# EasyEDA Pro project STM32G303的双FOC电机驱动.eprj, board motor_drivev1.3
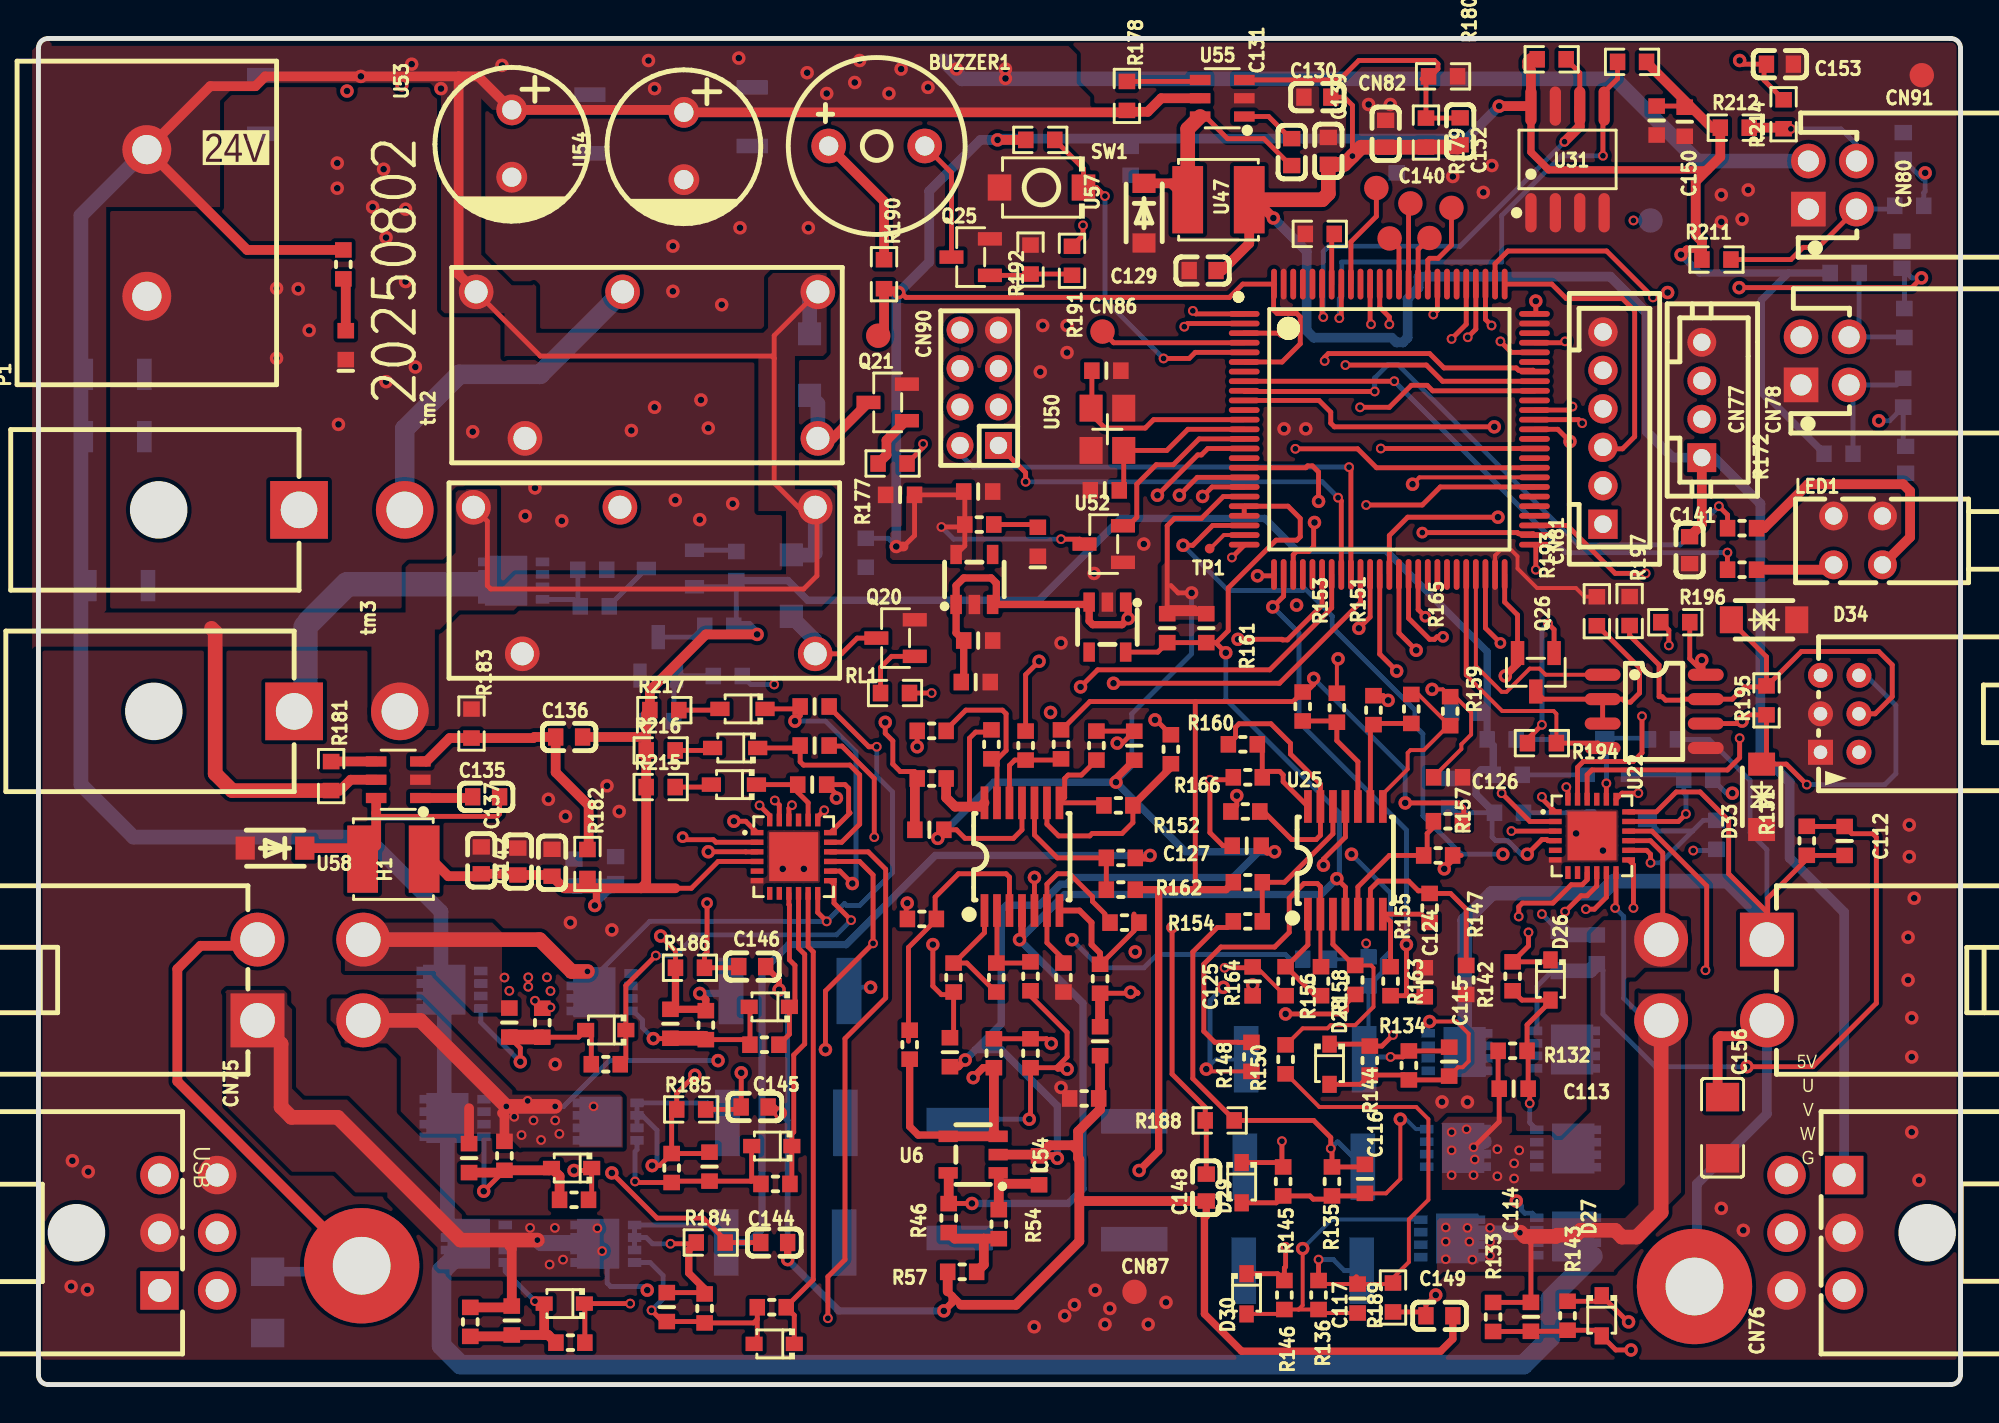
[diagram p11: board, top side]
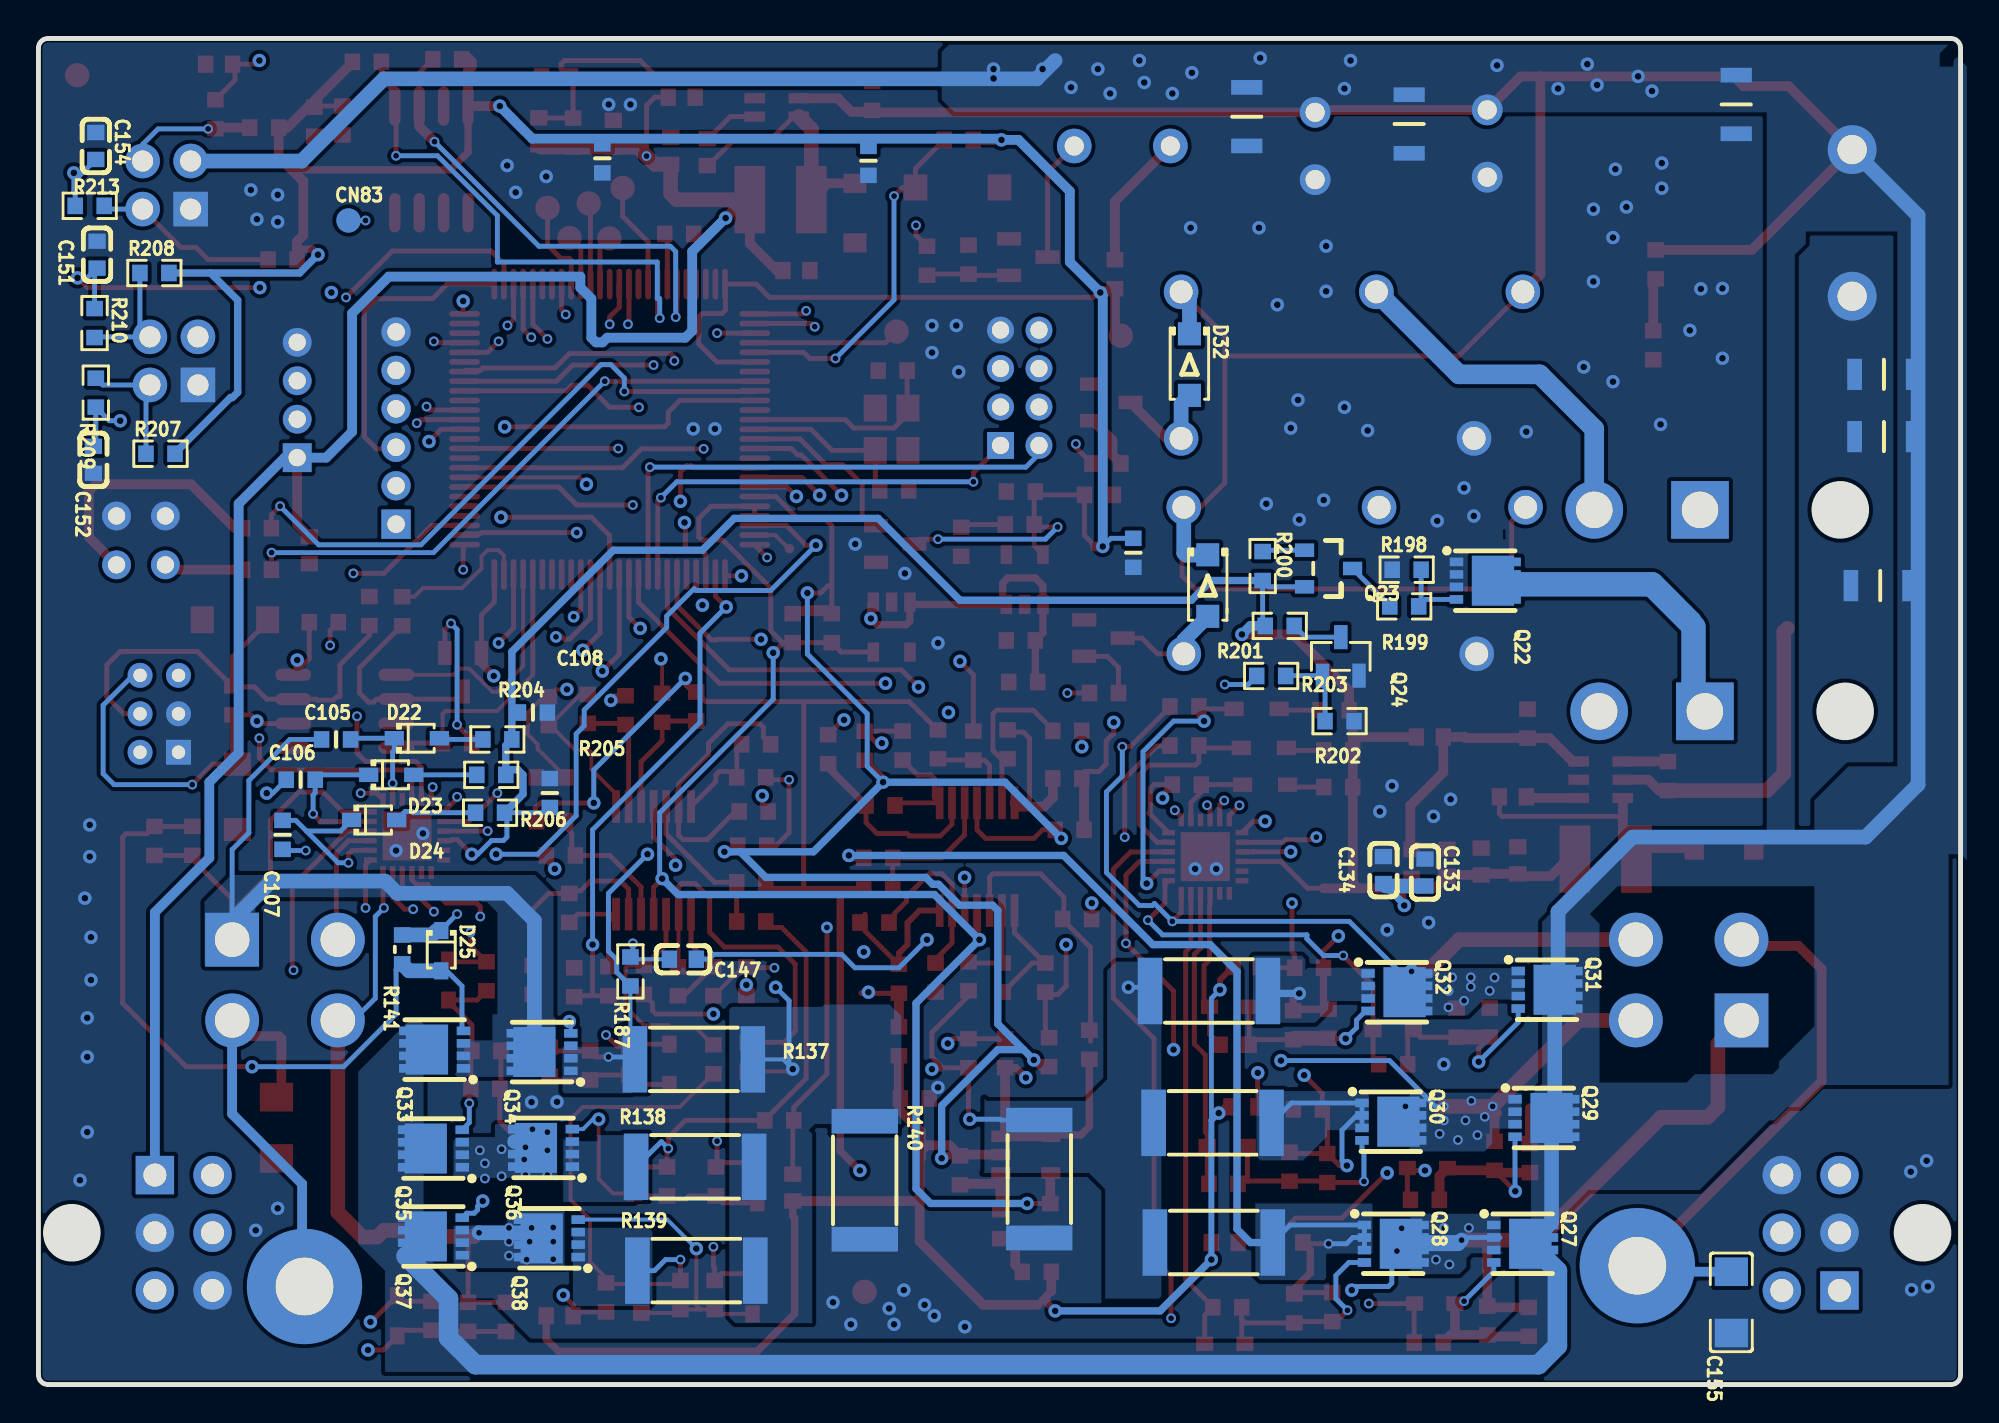
[diagram p12: board, bottom side, seen from below]

Outline 100 x 70 mm; copper layers: Top Layer, Inner1, Inner2, Bottom Layer. Coordinates in mm from the lower left corner of the outline.
Outline path: 0,69.5 arc(0.15,69.85) 0.5,70 99.5,70 arc(99.85,69.85) 100,69.5 100,0.5 arc(99.85,0.15) 99.5,0 0.5,0 arc(0.15,0.15) 0,0.5 0,69.5
Stack: Top Layer 0.035mm 外层铜厚1oz / Dielectric1 0.2104mm 7628 RC49% 8.6mil / Inner1 0.0152mm 内层铜厚 / Dielectric2 1.065mm 1.1mm H/HOZ Copper / Inner2 0.0152mm 内层铜厚 / Dielectric3 0.2104mm 7628 RC49% 8.6mil / Bottom Layer 0.035mm 外层铜厚1oz

## Design rules (mm)
template: 用户自定义配置
spacing safeClearance (default): track to track 0.152, other pairs 0.152 to 0.203
track width trackWidth (default): min 0.203, default 0.254, max 2.54
differential pair differentialPair (default): width min 0.152, default 0.254, max 2.54; gap min 0.152, default 0.203
via viaSize (default): diameter min 0.5, default 0.711, max 10; hole min 0.3, default 0.381, max 5.999
via mid: diameter min 0.5, default 0.762, max 10; hole min 0.3, default 0.406, max 6.3

## Placement (name value [footprint] x y rotation side)
BUZZER1  3kHz  [BUZ-TH_BD9.0-P5.00-D0.6-FD]  43.61 64.41 0 top
C5  10uF  [C1206_S]  3.86 49.3 0 bottom
C6  10uF  [C1206_S]  28.69 65.68 270 bottom
C12  10uF  [C1206_S]  4.05 41.55 0 bottom
C13  10uF  [C1206_S]  3.86 52.53 0 bottom
C14  10uF  [C1206_S]  11.67 66.69 270 bottom
C15  10uF  [C1206_S]  37.14 66.06 270 bottom
C30  100nF  [C0603_S]  48.88 38.69 180 top
C31  100nF  [C0603_S]  84.19 65.74 90 top
C32  100nF  [C0603_S]  70.66 63.77 90 bottom
C33  100nF  [C0603_S]  56.82 63.65 90 bottom
C34  22pF  [C0603_S]  55.55 52.72 180 top
C35  22pF  [C0603_S]  55.49 46.5 0 top
C41  100nF  [C0603_S]  48.76 36.53 180 top
C42  100nF  [C0603_S]  58.73 39.33 270 top
C43  100nF  [C0603_S]  60.76 39.33 270 top
C54  10nF  [C0603_S]  52.06 11.13 270 top
C55  100nF  [C0603_S]  48.88 46.44 180 top
C56  100nF  [C0603_S]  43.04 43.26 90 bottom
C57  100nF  [C0603_S]  44.84 46.26 0 top
C61  1nF  [C0603_S]  55.23 17.86 90 top
C62  1nF  [C0603_S]  47.42 17.29 90 top
C63  1nF  [C0603_S]  24.63 3.32 270 top
C64  1nF  [C0603_S]  22.4 11.77 270 top
C65  1nF  [C0603_S]  24.5 18.81 270 top
C66  1uF  [C0603_S]  40.25 31.2 180 top
C67  1nF  [C0603_S]  57.01 33.23 90 top
C68  1nF  [C0603_S]  46.34 28.85 180 top
C69  100nF  [C0603_S]  73.39 30.75 270 bottom
C70  1uF  [C0603_S]  40.37 33.23 180 top
C71  1uF  [C0603_S]  40.37 35.26 180 top
C72  1nF  [C0603_S]  32.69 4.02 270 top
C73  1nF  [C0603_S]  34.91 11.32 270 top
C74  1nF  [C0603_S]  32.88 18.75 270 top
C105  1uF  [C0603_S]  84.51 33.55 180 bottom
C106  1uF  [C0603_S]  86.35 31.45 180 bottom
C107  1uF  [C0603_S]  87.3 28.59 90 bottom
C108  100nF  [C0603_S]  74.28 34.94 0 bottom
C112  1nF  [C0603_S]  93.97 28.28 90 top
C113  1nF  [C0603_S]  76.76 15.39 0 top
C114  1nF  [C0603_S]  77.65 3.51 270 top
C115  1nF  [C0603_S]  73.39 16.78 270 top
C116  1nF  [C0603_S]  69.01 10.69 270 top
C117  1nF  [C0603_S]  68.63 4.46 270 top
C124  1nF  [C0603_S]  72.12 20.91 270 top
C125  1nF  [C0603_S]  63.17 20.97 90 top
C126  1nF  [C0603_S]  73.33 31.58 180 top
C127  1nF  [C0603_S]  62.85 28.02 180 top
C129  22uF  [C0603]  60.57 57.93 0 top
C130  22uF  [C0603]  66.54 66.95 0 top
C131  150pF  [C0603]  65.2 64.09 270 top
C132  100pF  [C0603]  73.96 65.17 270 top
C133  22uF  [C0603]  27.86 26.63 270 bottom
C134  22uF  [C0603]  30.02 26.75 270 bottom
C135  150pF  [C0603]  23.29 30.56 0 top
C136  100pF  [C0603]  27.61 33.67 0 top
C137  22uF  [C0603]  23.04 27.26 270 top
C138  100NF/6.3V  [C0603]  26.72 27.13 270 top
C139  100NF/6.3V  [C0603]  67.11 64.15 270 top
C140  100NF/6.3V  [C0603]  70.09 65.04 270 top
C141  100NF/6.3V  [C0603]  85.9 43.39 90 top
C142  100NF/6.3V  [C0603]  24.94 27.2 270 top
C144  10nF  [C0603]  38.28 7.38 180 top
C145  10nF  [C0603]  37.26 14.43 180 top
C146  10nF  [C0603]  37.14 21.74 180 top
C147  10nF  [C0603]  66.47 22.12 0 bottom
C148  10nF  [C0603]  60.76 10.24 90 top
C149  10nF  [C0603]  72.89 3.57 180 top
C150  100nF  [C0603_S]  85.65 65.68 90 top
C151  100nF  [C0603]  96.95 58.76 270 bottom
C152  100nF  [C0603]  97.14 48.09 90 bottom
C153  100nF  [C0603]  90.6 68.66 180 top
C154  100nF  [C0603]  97.02 64.41 270 bottom
C155  1nF  [C1206]  11.93 4.27 90 bottom
C156  1nF  [C1206]  87.62 13.35 270 top
CN75  HC-MX3.0-2*3AW  [CONN-TH_6P-P3.00_HC-MX3.0-2X3AW_1]  7.8 7.89 270 top
CN76  HC-MX3.0-2*3AW  [CONN-TH_6P-P3.00_HC-MX3.0-2X3AW_1]  92.44 7.89 90 top
CN77  BX-PH2.0-4PZZ-R  [CONN-TH_BX-PH2.0-4PZZ-R]  86.54 51.2 90 top
CN78  HC-XHD-2*2AW  [CONN-TH_4P-P2.50_HCTL_HC-XHD-2X2AW]  92.95 53.23 90 top
CN80  HC-XHD-2*2AW  [CONN-TH_4P-P2.50_HCTL_HC-XHD-2X2AW]  93.33 62.38 90 top
CN81  BX-PH2.0-6PZZ-Y  [CONN-TH_6P-P2.00_BX-PH2.0-6PZZ-Y]  81.39 49.74 90 top
CN82  5012  [TESTPOINT-TH_BD2.0_C9900010656]  69.61 62.22 0 top
CN83  5012  [TESTPOINT-TH_BD2.0_C9900010656]  83.87 60.53 180 bottom
CN84  5012  [TESTPOINT-TH_BD2.0_C9900010656]  73.51 61.19 0 top
CN85  5012  [TESTPOINT-TH_BD2.0_C9900010656]  72.37 59.62 0 top
CN86  5012  [TESTPOINT-TH_BD2.0_C9900010656]  55.36 54.76 0 top
CN87  5012  [TESTPOINT-TH_BD2.0_C9900010656]  57.02 4.82 0 top
CN88  5012  [TESTPOINT-TH_BD2.0_C9900010656]  71.38 61.42 0 top
CN89  5012  [TESTPOINT-TH_BD2.0_C9900010656]  70.3 59.6 0 top
CN90  5012  [TESTPOINT-TH_BD2.0_C9900010656]  43.69 54.54 0 top
CN91  5012  [TESTPOINT-TH_BD2.0_C9900010656]  97.98 68.09 0 top
D5  B16WS  [SOD-323_L1.8-W1.3-LS2.5-RD]  27.36 4.21 180 top
D6  B16WS  [SOD-323_L1.8-W1.3-LS2.5-RD]  27.74 11.26 180 top
D7  B16WS  [SOD-323_L1.8-W1.3-LS2.5-RD]  29.52 18.43 180 top
D8  B16WS  [SOD-323_L1.8-W1.3-LS2.5-RD#2]  36.18 31.2 180 top
D9  B16WS  [SOD-323_L1.8-W1.3-LS2.5-RD#2]  36.25 33.1 180 top
D10  B16WS  [SOD-323_L1.8-W1.3-LS2.5-RD#2]  36.63 35.13 180 top
D11  B16WS  [SOD-323_L1.8-W1.3-LS2.5-RD]  38.28 2.11 180 top
D12  B16WS  [SOD-323_L1.8-W1.3-LS2.5-RD]  38.15 12.4 180 top
D13  B16WS  [SOD-323_L1.8-W1.3-LS2.5-RD]  38.02 19.64 180 top
D22  B16WS  [SOD-323_L1.8-W1.3-LS2.5-RD#2]  80.32 33.61 180 bottom
D23  B16WS  [SOD-323_L1.8-W1.3-LS2.5-RD#2]  81.65 31.71 180 bottom
D24  B16WS  [SOD-323_L1.8-W1.3-LS2.5-RD#2]  82.54 29.36 180 bottom
D25  B16WS  [SOD-323_L1.8-W1.3-LS2.5-RD]  79.05 22.56 270 bottom
D26  B16WS  [SOD-323_L1.8-W1.3-LS2.5-RD]  78.66 21.04 270 top
D27  B16WS  [SOD-323_L1.8-W1.3-LS2.5-RD]  81.33 3.57 270 top
D28  B16WS  [SOD-323_L1.8-W1.3-LS2.5-RD]  67.17 16.66 270 top
D29  B16WS  [SOD-323_L1.8-W1.3-LS2.5-RD]  62.6 10.5 270 top
D30  B16WS  [SOD-323_L1.8-W1.3-LS2.5-RD]  62.85 4.72 270 top
D31  1N4007 A7  [SOD-123FL_L2.8-W1.8-LS3.7-RD]  39.17 41.55 270 bottom
D32  1N4007 A7  [SOD-123FL_L2.8-W1.8-LS3.7-RD]  40.12 53.04 270 bottom
D33  SMF6.8CA  [SOD-123FL_L2.8-W1.8-LS3.7-BI]  89.65 30.56 90 top
D34  SMF6.8CA  [SOD-123FL_L2.8-W1.8-LS3.7-BI]  89.78 39.77 180 top
H1  HC-5557-2*2AW  [CONN-TH_4P-P4.20_5557-2X2AW]  14.15 21.04 270 top
H2  HC-5557-2*2AW  [CONN-TH_4P-P4.20_5557-2X2AW]  87.17 21.03 90 top
L1  NCD0603R1  [LED0603_S]  15.99 53.42 270 top
L3  NCD0603R1  [LED0603_S]  51.99 43.2 270 top
LED1  MHK2310GEBTD  [LED-TH_4P-L12.8-W4.4_C9900044135]  94.67 43.9 0 top
NOREF  -  [Pad_e15]  16.81 6.18 0 top
NOREF#2  -  [Pad_e9]  86.16 5.1 0 top
P1  WJ25C-B-7.62-2P  [CONN-TH_2P-P7.62_WJ25C-B-7.62-2P]  5.64 60.41 90 top
Q20  AO3400C  [SOT-23-3_L2.9-W1.3-P1.90-LS2.4-BR]  44.59 38.82 0 top
Q21  AO3400C  [SOT-23-3_L2.9-W1.3-P1.90-LS2.4-BR]  44.18 51.07 0 top
Q22  BSZ040N04A  [POWERPAK-1212-8_L3.1-W3.1-P0.65-LS3.3-BL]  24.73 41.8 270 bottom
Q23  MMBT5401-2Z  [SOT-23-3_L2.9-W1.4-P1.90-LS2.4-TR]  32.88 42.44 0 bottom
Q24  MMBT5551-G1  [SOT-23-3_L2.9-W1.3-P1.90-LS2.4-BR]  32.25 37.86 270 bottom
Q25  MMBT5551-G1  [SOT-23-3_L2.9-W1.3-P1.90-LS2.4-BR]  48.5 58.63 0 top
Q26  SS8550 Y2(RANGE:200-350)  [SOT-23-3_L2.9-W1.3-P1.90-LS2.4-BR]  77.9 37.04 90 top
Q27  BSZ040N04A  [POWERPAK-1212-8_L3.1-W3.1-P0.65-LS3.3-BL]  22.78 7.32 270 bottom
Q28  BSZ040N04A  [POWERPAK-1212-8_L3.1-W3.1-P0.65-LS3.3-BL]  29.52 7.32 270 bottom
Q29  BSZ040N04A  [POWERPAK-1212-8_L3.1-W3.1-P0.65-LS3.3-BL]  21.68 13.86 270 bottom
Q30  BSZ040N04A  [POWERPAK-1212-8_L3.1-W3.1-P0.65-LS3.3-BL]  29.64 13.67 270 bottom
Q31  BSZ040N04A  [POWERPAK-1212-8_L3.1-W3.1-P0.65-LS3.3-BL]  21.51 20.53 270 bottom
Q32  BSZ040N04A  [POWERPAK-1212-8_L3.1-W3.1-P0.65-LS3.3-BL]  29.32 20.4 270 bottom
Q33  BSZ040N04A  [POWERPAK-1212-8_L3.1-W3.1-P0.65-LS3.3-BL]  79.39 17.42 90 bottom
Q34  BSZ040N04A  [POWERPAK-1212-8_L3.1-W3.1-P0.65-LS3.3-BL]  73.8 17.29 90 bottom
Q35  BSZ040N04A  [POWERPAK-1212-8_L3.1-W3.1-P0.65-LS3.3-BL]  79.45 12.27 90 bottom
Q36  BSZ040N04A  [POWERPAK-1212-8_L3.1-W3.1-P0.65-LS3.3-BL]  73.72 12.31 90 bottom
Q37  BSZ040N04A  [POWERPAK-1212-8_L3.1-W3.1-P0.65-LS3.3-BL]  79.45 7.7 90 bottom
Q38  BSZ040N04A  [POWERPAK-1212-8_L3.1-W3.1-P0.65-LS3.3-BL]  73.42 7.6 90 bottom
R1  10kΩ  [R0603_S]  15.86 58.25 90 top
R12  0Ω  [R0603_S]  54.41 14.88 180 top
R14  1kΩ  [R0603_S]  48.95 44.72 0 top
R28  1kΩ  [R0603_S]  88.63 42.37 180 top
R41  20kΩ  [R0603_S]  56.5 24.02 180 top
R42  20kΩ  [R0603_S]  49.83 21.16 90 top
R44  1kΩ  [R0603_S]  53.33 21.16 90 top
R45  1kΩ  [R0603_S]  51.61 21.23 90 top
R46  10kΩ  [R0603_S]  47.36 8.66 90 top
R49  1kΩ  [R0603_S]  51.61 17.23 90 top
R50  22Ω  [R0603_S]  55.23 21.1 90 top
R51  20kΩ  [R0603_S]  49.71 17.23 90 top
R52  1kΩ  [R0603_S]  45.96 24.21 0 top
R53  22Ω  [R0603_S]  47.61 21.16 90 top
R54  0Ω  [R0603_S]  49.96 8.34 90 top
R55  20kΩ  [R0603_S]  45.33 17.67 90 top
R57  10kΩ  [R0603_S]  48.06 5.86 0 top
R59  22Ω  [R0603_S]  27.67 2.18 0 top
R60  22Ω  [R0603_S]  27.86 9.61 0 top
R61  22Ω  [R0603_S]  29.52 16.66 0 top
R62  10kΩ  [R0603_S]  22.47 3.26 90 top
R63  10kΩ  [R0603_S]  24.24 11.89 90 top
R64  10kΩ  [R0603_S]  26.21 18.81 90 top
R65  20kΩ  [R0603_S]  56.18 30.12 0 top
R66  20kΩ  [R0603_S]  49.58 33.29 270 top
R67  1kΩ  [R0603_S]  58.92 33.04 270 top
R68  1kΩ  [R0603_S]  46.47 33.99 0 top
R69  1kΩ  [R0603_S]  56.31 27.39 180 top
R70  22Ω  [R0603_S]  55.04 33.23 270 top
R71  20kΩ  [R0603_S]  56.31 25.74 180 top
R72  1kΩ  [R0603_S]  51.36 33.23 270 top
R73  22Ω  [R0603_S]  46.47 31.52 0 top
R74  20kΩ  [R0603_S]  53.2 33.29 270 top
R75  22Ω  [R0603_S]  38.15 4.02 0 top
R76  22Ω  [R0603_S]  38.34 10.43 0 top
R77  22Ω  [R0603_S]  37.77 17.67 0 top
R78  10kΩ  [R0603_S]  34.66 3.96 90 top
R79  10kΩ  [R0603_S]  32.94 11.26 90 top
R80  10kΩ  [R0603_S]  34.72 18.69 90 top
R81  1mΩ  [R2512_S]  38.85 7.38 0 bottom
R82  1mΩ  [R2512_S]  38.91 13.61 0 bottom
R83  1mΩ  [R2512_S]  39.1 20.47 0 bottom
R109  1mΩ  [R2512_S]  47.93 10.69 270 bottom
R131  10kΩ  [R0603_S]  92 28.28 270 top
R132  10kΩ  [R0603_S]  76.7 17.35 180 top
R133  10kΩ  [R0603_S]  75.68 3.51 90 top
R134  10kΩ  [R0603_S]  71.3 16.59 90 top
R135  10kΩ  [R0603_S]  67.3 10.56 90 top
R136  10kΩ  [R0603_S]  66.6 4.65 90 top
R137  1mΩ  [R2512_S]  65.9 16.91 180 bottom
R138  1mΩ  [R2512_S]  65.84 11.32 180 bottom
R139  1mΩ  [R2512_S]  65.77 5.92 180 bottom
R140  1mΩ  [R2512_S]  57.01 10.62 270 bottom
R141  22Ω  [R0603_S]  81.08 22.62 90 bottom
R142  22Ω  [R0603_S]  76.7 21.23 90 top
R143  22Ω  [R0603_S]  79.55 3.57 90 top
R144  22Ω  [R0603_S]  69.27 16.85 90 top
R145  22Ω  [R0603_S]  64.76 10.56 90 top
R146  22Ω  [R0603_S]  64.82 4.65 90 top
R147  1kΩ  [R0603_S]  74.28 21.04 90 top
R148  1kΩ  [R0603_S]  63.11 17.04 90 top
R149  1kΩ  [R0603_S]  72.82 27.51 180 top
R150  1kΩ  [R0603_S]  64.88 16.91 90 top
R151  1kΩ  [R0603_S]  69.46 35.07 270 top
R152  1kΩ  [R0603_S]  62.79 29.8 0 top
R153  1kΩ  [R0603_S]  67.55 35.2 270 top
R154  1kΩ  [R0603_S]  62.92 24.09 0 top
R155  20kΩ  [R0603_S]  72.38 24.78 90 top
R156  20kΩ  [R0603_S]  66.73 20.97 90 top
R157  20kΩ  [R0603_S]  73.33 29.29 180 top
R158  20kΩ  [R0603_S]  68.5 21.04 90 top
R159  20kΩ  [R0603_S]  71.42 35.13 270 top
R160  20kΩ  [R0603_S]  62.66 33.29 180 top
R161  20kΩ  [R0603_S]  65.77 35.26 270 top
R162  20kΩ  [R0603_S]  62.92 26.12 0 top
R163  22Ω  [R0603_S]  70.35 20.97 90 top
R164  22Ω  [R0603_S]  64.88 20.97 90 top
R165  22Ω  [R0603_S]  73.45 35.02 270 top
R166  22Ω  [R0603_S]  62.92 31.58 0 top
R167  1k  [R0603]  66.66 59.84 180 top
R172  1kΩ  [R0603_S]  88.63 44.53 180 top
R173  22kΩ  [R0603]  78.73 68.92 180 top
R174  22kΩ  [R0603]  82.91 68.78 0 top
R175  10kΩ  [R0603]  52.12 64.73 180 top
R176  100kΩ  [R0603]  44.56 35.96 0 top
R177  100kΩ  [R0603]  44.44 47.9 0 top
R178  1M  [R0603]  56.63 67.01 270 top
R179  47kΩ  [R0603]  72.19 65.11 270 top
R180  9.1kΩ  [R0603]  73.08 68.03 180 top
R181  1M  [R0603]  15.23 31.64 270 top
R182  47kΩ  [R0603]  28.56 27.07 270 top
R183  15K  [R0603]  22.53 34.37 270 top
R184  10kΩ  [R0603]  34.98 7.38 0 top
R185  10kΩ  [R0603]  33.96 14.31 0 top
R186  10kΩ  [R0603]  33.9 21.67 0 top
R187  10kΩ  [R0603]  69.2 21.48 90 bottom
R188  10kΩ  [R0603]  61.46 13.74 180 top
R189  10kΩ  [R0603]  70.47 4.53 270 top
R190  100R  [R0603]  43.99 57.74 270 top
R191  10kΩ  [R0603]  53.77 58.44 90 top
R192  10kΩ  [R0603]  51.61 58.5 270 top
R193  3.3kΩ  [R0603]  81.08 40.21 270 top
R194  10kΩ  [R0603]  78.22 33.36 180 top
R195  120Ω  [R0603]  89.9 35.58 90 top
R196  10kΩ  [R0603]  85.16 39.64 0 top
R197  10kΩ  [R0603]  82.78 40.22 270 top
R198  10K  [R0603]  28.82 42.37 180 bottom
R199  47R  [R0603]  28.94 40.47 180 bottom
R200  10K  [R0603]  36.31 42.56 90 bottom
R201  10K  [R0603]  35.42 39.45 180 bottom
R202  10K  [R0603]  32.31 34.5 180 bottom
R203  1K  [R0603]  35.86 36.85 0 bottom
R204  22R  [R0603]  76.12 33.55 0 bottom
R205  22R  [R0603]  76.44 31.71 0 bottom
R206  22R  [R0603]  76.51 29.74 0 bottom
R207  10K  [R0603]  93.65 48.41 180 bottom
R208  10K  [R0603]  93.97 57.8 180 bottom
R209  1k  [R0603]  97.02 51.58 90 bottom
R210  1k  [R0603]  97.08 55.2 270 bottom
R211  10K  [R0603]  87.3 58.5 180 top
R212  10K  [R0603]  88.25 65.36 180 top
R213  1k  [R0603]  97.33 61.3 180 bottom
R214  1k  [R0603]  90.79 66.06 270 top
R215  22R  [R0603]  32.37 31.07 0 top
R216  22R  [R0603]  32.37 32.98 0 top
R217  22R  [R0603]  32.56 35.07 0 top
RL1  G5Q-14 DC24  [RELAY-TH_G5Q-14-DCXX]  31.52 41.81 180 top
RL2  G5Q-14 DC24  [RELAY-TH_G5Q-14-DCXX]  31.66 53.01 180 top
SW1  TS-1088-AR02016  [SW-SMD_L3.9-W3.0-P4.45]  52.18 62.25 0 top
tm2  X5700WR-2x01-LPSW  [CONN-TH_2P-P5.70_XKB_X5700WR-2X01-LPSW]  16.31 45.48 270 top
tm3  X5700WR-2x01-LPSW  [CONN-TH_2P-P5.70_XKB_X5700WR-2X01-LPSW]  16.05 35.01 270 top
TP1  -  [Test-Point-0.5mm]  60.93 43.47 0 top
U3  XC6210B332MR  [SOT-23-5_L3.0-W1.7-P0.95-LS2.8-BR]  48.69 41.87 270 top
U4  LP5907QMFX-3.3Q1  [SOT-23-5_L3.0-W1.7-P0.95-LS2.8-BR]  55.61 39.39 90 top
U6  LM321MF/NOPB  [SOT-23-5_L3.0-W1.7-P0.95-LS2.8-BR]  48.63 11.96 0 top
U7  FD6288Q  [QFN-24_L4.0-W4.0-P0.50-BL-EP2.6]  39.29 27.45 270 top
U10  RS624XQ  [TSSOP-14_L5.0-W4.4-P0.65-LS6.4-BL]  51.17 27.45 0 top
U22  FD6288Q  [QFN-24_L4.0-W4.0-P0.50-BL-EP2.6]  80.82 28.53 270 top
U25  RS624XQ  [TSSOP-14_L5.0-W4.4-P0.65-LS6.4-BL]  68 27.26 0 top
U31  BM24C16B/M24C16-RMN6TP/24LC16BT-I/SN  [SOIC-8_L4.9-W3.9-P1.27-LS6.0-BL]  79.55 63.71 0 top
U32  STM32F303VBT6  [LQFP-100_L14.0-W14.0-P0.50-LS16.0-BL]  70.28 49.68 270 top
U41  SP3485  [SOP-8_L4.9-W3.9-P1.27-LS6.0-BL]  84.06 35.01 270 top
U42  HC-PHB2.0-2x3AW  [CONN-TH_6P-P2.00_HC-PHB2.0-2X3AW]  93.71 34.88 270 top
U47  6.8uH  [IND-SMD_L4.0-W4.0]  61.39 61.61 0 top
U49  6.8uH  [IND-SMD_L4.0-W4.0]  18.47 27.32 0 top
U50  PH2.0H2.0L-2*4P2*42mm  [HDR-TH_8P-P2.00-V-M-R2-C4-S2.00]  48.95 51.84 90 top
U52  IMP809JEUR/T  [SOT-23-3_L2.9-W1.3-P1.90-LS2.4-BR]  55.42 43.71 0 top
U53  220uF/35V  [CAP-TH_BD8.0-P3.50-D0.6-FD_1]  24.63 64.53 270 top
U54  220uF/35V  [CAP-TH_BD8.0-P3.50-D0.6-FD_1]  33.58 64.41 270 top
U55  ME3116AM6G  [SOT-23-6_L2.9-W1.6-P0.95-LS2.8-BL]  61.59 66.89 90 top
U56  ME3116AM6G  [SOT-23-6_L2.9-W1.6-P0.95-LS2.8-BL]  18.72 31.45 90 top
U57  SS14-SOD123FLA  [SOD-123F_L2.8-W1.7-LS3.7-RD]  57.52 60.92 270 top
U58  SS14-SOD123FLA  [SOD-123F_L2.8-W1.7-LS3.7-RD]  12.31 27.9 180 top
X1  8MHz  [CRYSTAL-SMD_4P-L3.2-W2.5-BL]  55.61 49.68 270 top

## Footprints (pads in the part's own frame, mm; a bottom-side part is the same pattern mirrored in y, then rotated)
BUZ-TH_BD9.0-P5.00-D0.6-FD
  round 1.8 hole 1: 1(-2.5,0) 2(2.5,0)
C0603
  rect 0.8x0.9 smd: 1(-0.7,0) 2(0.7,0)
C0603_S
  rect 0.806x0.864 smd: 1(-0.762,0) 2(0.745,0)
C1206
  rect 1.485x1.728 smd: 1(-1.593,0) 2(1.593,0)
C1206_S
  rect 0.762x1.625 smd: 1(1.651,0) 2(-1.397,0)
CAP-TH_BD8.0-P3.50-D0.6-FD_1
  round 1.6 hole 1: 1(-1.75,0) 2(1.75,0)
CONN-TH_2P-P5.70_XKB_X5700WR-2X01-LPSW
  rect 3x3 hole 1.9: 1(0,-2.75)
  round 3 hole 1.9: 2(0,2.75)
CONN-TH_2P-P7.62_WJ25C-B-7.62-2P
  round 2.54 hole 1.524: 1(-3.812,0) 2(3.812,0)
CONN-TH_4P-P2.50_HCTL_HC-XHD-2X2AW
  rect 1.8x1.8 hole 1.1: 1(-1.25,1.25)
  round 1.8 hole 1.1: 2(-1.25,-1.25) 3(1.25,1.25) 4(1.25,-1.25)
CONN-TH_4P-P4.20_5557-2X2AW
  rect 2.8x2.8 hole 1.8: 1(2.1,-2.75)
  round 2.8 hole 1.8: 2(-2.1,-2.75) 3(2.1,2.75) 4(-2.1,2.75)
CONN-TH_6P-P2.00_BX-PH2.0-6PZZ-Y
  rect 1.524x1.524 hole 0.914: 1(-5,0)
  round 1.524 hole 0.914: 2(-3,0) 3(-1,0) 4(1,0) 5(3,0) 6(5,0)
CONN-TH_6P-P2.00_HC-PHB2.0-2X3AW
  rect 1.3x1.3 hole 0.7: 1(2,-1)
  round 1.3 hole 0.7: 2(2,1) 3(0,-1) 4(0,1) 5(-2,-1) 6(-2,1)
CONN-TH_6P-P3.00_HC-MX3.0-2X3AW_1
  rect 2x2 hole 1.2: 1(3,-1.5)
  round 2 hole 1.2: 2(3,1.5) 3(0,-1.5) 4(0,1.5) 5(-3,-1.5) 6(-3,1.5)
CONN-TH_BX-PH2.0-4PZZ-R
  rect 1.5x1.5 hole 0.9: 1(-3,0)
  round 1.5 hole 0.9: 2(-1,0) 3(1,0) 4(3,0)
CRYSTAL-SMD_4P-L3.2-W2.5-BL
  rect 1.4x1.2 smd: 1(-1.1,-0.85) 2(1.1,-0.85) 3(1.1,0.85) 4(-1.1,0.85)
HDR-TH_8P-P2.00-V-M-R2-C4-S2.00
  rect 1.4x1.4 hole 0.9: 1(-3,-1)
  round 1.4 hole 0.9: 2(-3,1) 3(-1,-1) 4(-1,1) 5(1,-1) 6(1,1) 7(3,-1) 8(3,1)
IND-SMD_L4.0-W4.0
  rect 1.6x3.5 smd: 1(-1.6,0) 2(1.6,0)
LED0603_S
  rect 0.806x0.864 smd: 1(-1.381,-0.001) 2(0.126,-0.001)
LED-TH_4P-L12.8-W4.4_C9900044135
  round 1.5 hole 0.9: 1(-1.27,1.27) 2(-1.27,-1.27) 3(1.27,-1.27) 4(1.27,1.27)
LQFP-100_L14.0-W14.0-P0.50-LS16.0-BL
  oval 0.3x1.6 smd: 1(-6,-7.55) 2(-5.5,-7.55) 3(-5,-7.55) 4(-4.5,-7.55) 5(-4,-7.55) 6(-3.5,-7.55) 7(-3,-7.55) 8(-2.5,-7.55) 9(-2,-7.55) 10(-1.5,-7.55) 11(-1,-7.55) 12(-0.5,-7.55) 13(0,-7.55) 14(0.5,-7.55) 15(1,-7.55) 16(1.5,-7.55) 17(2,-7.55) 18(2.5,-7.55) 19(3,-7.55) 20(3.5,-7.55) 21(4,-7.55) 22(4.5,-7.55) 23(5,-7.55) 24(5.5,-7.55) 25(6,-7.55) 51(6,7.55) 52(5.5,7.55) 53(5,7.55) 54(4.5,7.55) 55(4,7.55) 56(3.5,7.55) 57(3,7.55) 58(2.5,7.55) 59(2,7.55) 60(1.5,7.55) 61(1,7.55) 62(0.5,7.55) 63(0,7.55) 64(-0.5,7.55) 65(-1,7.55) 66(-1.5,7.55) 67(-2,7.55) 68(-2.5,7.55) 69(-3,7.55) 70(-3.5,7.55) 71(-4,7.55) 72(-4.5,7.55) 73(-5,7.55) 74(-5.5,7.55) 75(-6,7.55)
  oval 1.6x0.3 smd: 26(7.55,-6) 27(7.55,-5.5) 28(7.55,-5) 29(7.55,-4.5) 30(7.55,-4) 31(7.55,-3.5) 32(7.55,-3) 33(7.55,-2.5) 34(7.55,-2) 35(7.55,-1.5) 36(7.55,-1) 37(7.55,-0.5) 38(7.55,0) 39(7.55,0.5) 40(7.55,1) 41(7.55,1.5) 42(7.55,2) 43(7.55,2.5) 44(7.55,3) 45(7.55,3.5) 46(7.55,4) 47(7.55,4.5) 48(7.55,5) 49(7.55,5.5) 50(7.55,6) 76(-7.55,6) 77(-7.55,5.5) 78(-7.55,5) 79(-7.55,4.5) 80(-7.55,4) 81(-7.55,3.5) 82(-7.55,3) 83(-7.55,2.5) 84(-7.55,2) 85(-7.55,1.5) 86(-7.55,1) 87(-7.55,0.5) 88(-7.55,0) 89(-7.55,-0.5) 90(-7.55,-1) 91(-7.55,-1.5) 92(-7.55,-2) 93(-7.55,-2.5) 94(-7.55,-3) 95(-7.55,-3.5) 96(-7.55,-4) 97(-7.55,-4.5) 98(-7.55,-5) 99(-7.55,-5.5) 100(-7.55,-6)
Pad_e9
  round 6 hole 3: 1(0,0)
Pad_e15
  round 6 hole 3: 1(0,0)
POWERPAK-1212-8_L3.1-W3.1-P0.65-LS3.3-BL
  rect 0.45x0.7 smd: 1(-0.975,-1.5) 2(-0.325,-1.5) 3(0.325,-1.5) 4(0.975,-1.5) 5(0.975,1.5) 6(0.325,1.5) 7(-0.325,1.5) 8(-0.975,1.5)
  rect 2.6x2.2 smd: 8(0,0.4)
QFN-24_L4.0-W4.0-P0.50-BL-EP2.6
  rect 0.28x0.665 smd: 1(-1.25,-1.907) 2(-0.75,-1.907) 3(-0.25,-1.907) 4(0.25,-1.907) 5(0.75,-1.907) 6(1.25,-1.907) 13(1.25,1.907) 14(0.75,1.907) 15(0.25,1.907) 16(-0.25,1.907) 17(-0.75,1.907) 18(-1.25,1.907)
  rect 0.665x0.28 smd: 7(1.907,-1.25) 8(1.907,-0.75) 9(1.907,-0.25) 10(1.907,0.25) 11(1.907,0.75) 12(1.907,1.25) 19(-1.907,1.25) 20(-1.907,0.75) 21(-1.907,0.25) 22(-1.907,-0.25) 23(-1.907,-0.75) 24(-1.907,-1.25)
  rect 2.55x2.55 smd: 25(0,0)
R0603
  rect 0.806x0.864 smd: 1(-0.753,0) 2(0.753,0)
R0603_S
  rect 0.806x0.864 smd: 1(-0.752,0) 2(0.754,0)